# EAGLE board Resistor_Resistor (EAGLE 8.3.0), part 25 of 32
## Placement (x,y rotation side) (continued)
R30455  10K  [0201]  210.67,34.19 0 top
R30456  10K  [0201]  210.67,34.8 0 top
R30457  10K  [0201]  210.67,35.41 0 top
R30458  10K  [0201]  210.67,36.02 0 top
R30459  10K  [0201]  210.67,36.63 0 top
R30460  10K  [0201]  210.67,37.24 0 top
R30461  10K  [0201]  210.67,37.85 0 top
R30462  10K  [0201]  210.67,38.46 0 top
R30463  10K  [0201]  210.67,39.07 0 top
R30464  10K  [0201]  210.67,39.67 0 top
R30465  10K  [0201]  210.67,40.28 0 top
R30466  10K  [0201]  210.67,40.89 0 top
R30467  10K  [0201]  210.67,41.5 0 top
R30468  10K  [0201]  210.67,42.11 0 top
R30469  10K  [0201]  210.67,42.72 0 top
R30470  10K  [0201]  210.67,43.33 0 top
R30471  10K  [0201]  210.67,43.94 0 top
R30472  10K  [0201]  210.67,44.55 0 top
R30473  10K  [0201]  210.67,45.16 0 top
R30474  10K  [0201]  210.67,45.77 0 top
R30475  10K  [0201]  210.67,46.38 0 top
R30476  10K  [0201]  210.67,46.99 0 top
R30477  10K  [0201]  210.67,47.6 0 top
R30478  10K  [0201]  210.67,48.21 0 top
R30479  10K  [0201]  210.67,48.82 0 top
R30480  10K  [0201]  210.67,49.43 0 top
R30481  10K  [0201]  210.67,50.04 0 top
R30482  10K  [0201]  210.67,50.65 0 top
R30483  10K  [0201]  210.67,51.26 0 top
R30484  10K  [0201]  210.67,51.87 0 top
R30485  10K  [0201]  210.67,52.48 0 top
R30486  10K  [0201]  210.67,53.09 0 top
R30487  10K  [0201]  210.67,53.7 0 top
R30488  10K  [0201]  210.67,54.31 0 top
R30489  10K  [0201]  210.67,54.91 0 top
R30490  10K  [0201]  210.67,55.52 0 top
R30491  10K  [0201]  210.67,56.13 0 top
R30492  10K  [0201]  210.67,56.74 0 top
R30493  10K  [0201]  210.67,57.35 0 top
R30494  10K  [0201]  210.67,57.96 0 top
R30495  10K  [0201]  210.67,58.57 0 top
R30496  10K  [0201]  210.67,59.18 0 top
R30497  10K  [0201]  210.67,59.79 0 top
R30498  10K  [0201]  210.67,60.4 0 top
R30499  10K  [0201]  210.67,61.01 0 top
R30500  10K  [0201]  210.67,61.62 0 top
R30501  10K  [0201]  210.67,62.23 0 top
R30502  10K  [0201]  210.67,62.84 0 top
R30503  10K  [0201]  210.67,63.45 0 top
R30504  10K  [0201]  210.67,64.06 0 top
R30505  10K  [0201]  210.67,64.67 0 top
R30506  10K  [0201]  210.67,65.28 0 top
R30507  10K  [0201]  210.67,65.89 0 top
R30508  10K  [0201]  210.67,66.5 0 top
R30509  10K  [0201]  210.67,67.11 0 top
R30510  10K  [0201]  210.67,67.72 0 top
R30511  10K  [0201]  210.67,68.33 0 top
R30512  10K  [0201]  210.67,68.94 0 top
R30513  10K  [0201]  210.67,69.55 0 top
R30514  10K  [0201]  210.67,70.15 0 top
R30515  10K  [0201]  210.67,70.76 0 top
R30516  10K  [0201]  210.67,71.37 0 top
R30517  10K  [0201]  210.67,71.98 0 top
R30518  10K  [0201]  210.67,72.59 0 top
R30519  10K  [0201]  210.67,73.2 0 top
R30520  10K  [0201]  210.67,73.81 0 top
R30521  10K  [0201]  210.67,74.42 0 top
R30522  10K  [0201]  210.67,75.03 0 top
R30523  10K  [0201]  210.67,75.64 0 top
R30524  10K  [0201]  210.67,76.25 0 top
R30525  10K  [0201]  210.67,76.86 0 top
R30526  10K  [0201]  210.67,77.47 0 top
R30527  10K  [0201]  210.67,78.08 0 top
R30528  10K  [0201]  210.67,78.69 0 top
R30529  10K  [0201]  210.67,79.3 0 top
R30530  10K  [0201]  210.67,79.91 0 top
R30531  10K  [0201]  210.67,80.52 0 top
R30532  10K  [0201]  210.67,81.13 0 top
R30533  10K  [0201]  210.67,81.74 0 top
R30534  10K  [0201]  210.67,82.35 0 top
R30535  10K  [0201]  210.67,82.96 0 top
R30536  10K  [0201]  210.67,83.57 0 top
R30537  10K  [0201]  210.67,84.18 0 top
R30538  10K  [0201]  210.67,84.79 0 top
R30539  10K  [0201]  210.67,85.39 0 top
R30540  10K  [0201]  210.67,86 0 top
R30541  10K  [0201]  210.67,86.61 0 top
R30542  10K  [0201]  210.67,87.22 0 top
R30543  10K  [0201]  210.67,87.83 0 top
R30544  10K  [0201]  210.67,88.44 0 top
R30545  10K  [0201]  210.67,89.05 0 top
R30546  10K  [0201]  210.67,89.66 0 top
R30547  10K  [0201]  210.67,90.27 0 top
R30548  10K  [0201]  210.67,90.88 0 top
R30549  10K  [0201]  210.67,91.49 0 top
R30550  10K  [0201]  210.67,92.1 0 top
R30551  10K  [0201]  210.67,92.71 0 top
R30552  10K  [0201]  210.67,93.32 0 top
R30553  10K  [0201]  210.67,93.93 0 top
R30554  10K  [0201]  210.67,94.54 0 top
R30555  10K  [0201]  210.67,95.15 0 top
R30556  10K  [0201]  210.67,95.76 0 top
R30557  10K  [0201]  210.67,96.37 0 top
R30558  10K  [0201]  210.67,96.98 0 top
R30559  10K  [0201]  210.67,97.59 0 top
R30560  10K  [0201]  210.67,98.2 0 top
R30561  10K  [0201]  210.67,98.81 0 top
R30562  10K  [0201]  210.67,99.42 0 top
R30563  10K  [0201]  210.67,100.03 0 top
R30564  10K  [0201]  210.67,100.63 0 top
R30565  10K  [0201]  210.67,101.24 0 top
R30566  10K  [0201]  210.67,101.85 0 top
R30567  10K  [0201]  210.67,102.46 0 top
R30568  10K  [0201]  210.67,103.07 0 top
R30569  10K  [0201]  210.67,103.68 0 top
R30570  10K  [0201]  210.67,104.29 0 top
R30571  10K  [0201]  210.67,104.9 0 top
R30572  10K  [0201]  210.67,105.51 0 top
R30573  10K  [0201]  210.67,106.12 0 top
R30574  10K  [0201]  210.67,106.73 0 top
R30575  10K  [0201]  210.67,107.34 0 top
R30576  10K  [0201]  210.67,107.95 0 top
R30577  10K  [0201]  210.67,108.56 0 top
R30578  10K  [0201]  210.67,109.17 0 top
R30579  10K  [0201]  210.67,109.78 0 top
R30580  10K  [0201]  210.67,110.39 0 top
R30581  10K  [0201]  210.67,111 0 top
R30582  10K  [0201]  210.67,111.61 0 top
R30583  10K  [0201]  210.67,112.22 0 top
R30584  10K  [0201]  210.67,112.83 0 top
R30585  10K  [0201]  210.67,113.44 0 top
R30586  10K  [0201]  210.67,114.05 0 top
R30587  10K  [0201]  210.67,114.66 0 top
R30588  10K  [0201]  210.67,115.27 0 top
R30589  10K  [0201]  210.67,115.87 0 top
R30590  10K  [0201]  210.67,116.48 0 top
R30591  10K  [0201]  210.67,117.09 0 top
R30592  10K  [0201]  210.67,117.7 0 top
R30593  10K  [0201]  210.67,118.31 0 top
R30594  10K  [0201]  210.67,118.92 0 top
R30595  10K  [0201]  210.67,119.53 0 top
R30596  10K  [0201]  210.67,120.14 0 top
R30597  10K  [0201]  210.67,120.75 0 top
R30598  10K  [0201]  210.67,121.36 0 top
R30599  10K  [0201]  210.67,121.97 0 top
R30600  10K  [0201]  210.67,122.58 0 top
R30601  10K  [0201]  211.89,1.27 0 top
R30602  10K  [0201]  211.89,1.88 0 top
R30603  10K  [0201]  211.89,2.49 0 top
R30604  10K  [0201]  211.89,3.1 0 top
R30605  10K  [0201]  211.89,3.71 0 top
R30606  10K  [0201]  211.89,4.32 0 top
R30607  10K  [0201]  211.89,4.93 0 top
R30608  10K  [0201]  211.89,5.54 0 top
R30609  10K  [0201]  211.89,6.15 0 top
R30610  10K  [0201]  211.89,6.76 0 top
R30611  10K  [0201]  211.89,7.37 0 top
R30612  10K  [0201]  211.89,7.98 0 top
R30613  10K  [0201]  211.89,8.59 0 top
R30614  10K  [0201]  211.89,9.19 0 top
R30615  10K  [0201]  211.89,9.8 0 top
R30616  10K  [0201]  211.89,10.41 0 top
R30617  10K  [0201]  211.89,11.02 0 top
R30618  10K  [0201]  211.89,11.63 0 top
R30619  10K  [0201]  211.89,12.24 0 top
R30620  10K  [0201]  211.89,12.85 0 top
R30621  10K  [0201]  211.89,13.46 0 top
R30622  10K  [0201]  211.89,14.07 0 top
R30623  10K  [0201]  211.89,14.68 0 top
R30624  10K  [0201]  211.89,15.29 0 top
R30625  10K  [0201]  211.89,15.9 0 top
R30626  10K  [0201]  211.89,16.51 0 top
R30627  10K  [0201]  211.89,17.12 0 top
R30628  10K  [0201]  211.89,17.73 0 top
R30629  10K  [0201]  211.89,18.34 0 top
R30630  10K  [0201]  211.89,18.95 0 top
R30631  10K  [0201]  211.89,19.56 0 top
R30632  10K  [0201]  211.89,20.17 0 top
R30633  10K  [0201]  211.89,20.78 0 top
R30634  10K  [0201]  211.89,21.39 0 top
R30635  10K  [0201]  211.89,22 0 top
R30636  10K  [0201]  211.89,22.61 0 top
R30637  10K  [0201]  211.89,23.22 0 top
R30638  10K  [0201]  211.89,23.83 0 top
R30639  10K  [0201]  211.89,24.43 0 top
R30640  10K  [0201]  211.89,25.04 0 top
R30641  10K  [0201]  211.89,25.65 0 top
R30642  10K  [0201]  211.89,26.26 0 top
R30643  10K  [0201]  211.89,26.87 0 top
R30644  10K  [0201]  211.89,27.48 0 top
R30645  10K  [0201]  211.89,28.09 0 top
R30646  10K  [0201]  211.89,28.7 0 top
R30647  10K  [0201]  211.89,29.31 0 top
R30648  10K  [0201]  211.89,29.92 0 top
R30649  10K  [0201]  211.89,30.53 0 top
R30650  10K  [0201]  211.89,31.14 0 top
R30651  10K  [0201]  211.89,31.75 0 top
R30652  10K  [0201]  211.89,32.36 0 top
R30653  10K  [0201]  211.89,32.97 0 top
R30654  10K  [0201]  211.89,33.58 0 top
R30655  10K  [0201]  211.89,34.19 0 top
R30656  10K  [0201]  211.89,34.8 0 top
R30657  10K  [0201]  211.89,35.41 0 top
R30658  10K  [0201]  211.89,36.02 0 top
R30659  10K  [0201]  211.89,36.63 0 top
R30660  10K  [0201]  211.89,37.24 0 top
R30661  10K  [0201]  211.89,37.85 0 top
R30662  10K  [0201]  211.89,38.46 0 top
R30663  10K  [0201]  211.89,39.07 0 top
R30664  10K  [0201]  211.89,39.67 0 top
R30665  10K  [0201]  211.89,40.28 0 top
R30666  10K  [0201]  211.89,40.89 0 top
R30667  10K  [0201]  211.89,41.5 0 top
R30668  10K  [0201]  211.89,42.11 0 top
R30669  10K  [0201]  211.89,42.72 0 top
R30670  10K  [0201]  211.89,43.33 0 top
R30671  10K  [0201]  211.89,43.94 0 top
R30672  10K  [0201]  211.89,44.55 0 top
R30673  10K  [0201]  211.89,45.16 0 top
R30674  10K  [0201]  211.89,45.77 0 top
R30675  10K  [0201]  211.89,46.38 0 top
R30676  10K  [0201]  211.89,46.99 0 top
R30677  10K  [0201]  211.89,47.6 0 top
R30678  10K  [0201]  211.89,48.21 0 top
R30679  10K  [0201]  211.89,48.82 0 top
R30680  10K  [0201]  211.89,49.43 0 top
R30681  10K  [0201]  211.89,50.04 0 top
R30682  10K  [0201]  211.89,50.65 0 top
R30683  10K  [0201]  211.89,51.26 0 top
R30684  10K  [0201]  211.89,51.87 0 top
R30685  10K  [0201]  211.89,52.48 0 top
R30686  10K  [0201]  211.89,53.09 0 top
R30687  10K  [0201]  211.89,53.7 0 top
R30688  10K  [0201]  211.89,54.31 0 top
R30689  10K  [0201]  211.89,54.91 0 top
R30690  10K  [0201]  211.89,55.52 0 top
R30691  10K  [0201]  211.89,56.13 0 top
R30692  10K  [0201]  211.89,56.74 0 top
R30693  10K  [0201]  211.89,57.35 0 top
R30694  10K  [0201]  211.89,57.96 0 top
R30695  10K  [0201]  211.89,58.57 0 top
R30696  10K  [0201]  211.89,59.18 0 top
R30697  10K  [0201]  211.89,59.79 0 top
R30698  10K  [0201]  211.89,60.4 0 top
R30699  10K  [0201]  211.89,61.01 0 top
R30700  10K  [0201]  211.89,61.62 0 top
R30701  10K  [0201]  211.89,62.23 0 top
R30702  10K  [0201]  211.89,62.84 0 top
R30703  10K  [0201]  211.89,63.45 0 top
R30704  10K  [0201]  211.89,64.06 0 top
R30705  10K  [0201]  211.89,64.67 0 top
R30706  10K  [0201]  211.89,65.28 0 top
R30707  10K  [0201]  211.89,65.89 0 top
R30708  10K  [0201]  211.89,66.5 0 top
R30709  10K  [0201]  211.89,67.11 0 top
R30710  10K  [0201]  211.89,67.72 0 top
R30711  10K  [0201]  211.89,68.33 0 top
R30712  10K  [0201]  211.89,68.94 0 top
R30713  10K  [0201]  211.89,69.55 0 top
R30714  10K  [0201]  211.89,70.15 0 top
R30715  10K  [0201]  211.89,70.76 0 top
R30716  10K  [0201]  211.89,71.37 0 top
R30717  10K  [0201]  211.89,71.98 0 top
R30718  10K  [0201]  211.89,72.59 0 top
R30719  10K  [0201]  211.89,73.2 0 top
R30720  10K  [0201]  211.89,73.81 0 top
R30721  10K  [0201]  211.89,74.42 0 top
R30722  10K  [0201]  211.89,75.03 0 top
R30723  10K  [0201]  211.89,75.64 0 top
R30724  10K  [0201]  211.89,76.25 0 top
R30725  10K  [0201]  211.89,76.86 0 top
R30726  10K  [0201]  211.89,77.47 0 top
R30727  10K  [0201]  211.89,78.08 0 top
R30728  10K  [0201]  211.89,78.69 0 top
R30729  10K  [0201]  211.89,79.3 0 top
R30730  10K  [0201]  211.89,79.91 0 top
R30731  10K  [0201]  211.89,80.52 0 top
R30732  10K  [0201]  211.89,81.13 0 top
R30733  10K  [0201]  211.89,81.74 0 top
R30734  10K  [0201]  211.89,82.35 0 top
R30735  10K  [0201]  211.89,82.96 0 top
R30736  10K  [0201]  211.89,83.57 0 top
R30737  10K  [0201]  211.89,84.18 0 top
R30738  10K  [0201]  211.89,84.79 0 top
R30739  10K  [0201]  211.89,85.39 0 top
R30740  10K  [0201]  211.89,86 0 top
R30741  10K  [0201]  211.89,86.61 0 top
R30742  10K  [0201]  211.89,87.22 0 top
R30743  10K  [0201]  211.89,87.83 0 top
R30744  10K  [0201]  211.89,88.44 0 top
R30745  10K  [0201]  211.89,89.05 0 top
R30746  10K  [0201]  211.89,89.66 0 top
R30747  10K  [0201]  211.89,90.27 0 top
R30748  10K  [0201]  211.89,90.88 0 top
R30749  10K  [0201]  211.89,91.49 0 top
R30750  10K  [0201]  211.89,92.1 0 top
R30751  10K  [0201]  211.89,92.71 0 top
R30752  10K  [0201]  211.89,93.32 0 top
R30753  10K  [0201]  211.89,93.93 0 top
R30754  10K  [0201]  211.89,94.54 0 top
R30755  10K  [0201]  211.89,95.15 0 top
R30756  10K  [0201]  211.89,95.76 0 top
R30757  10K  [0201]  211.89,96.37 0 top
R30758  10K  [0201]  211.89,96.98 0 top
R30759  10K  [0201]  211.89,97.59 0 top
R30760  10K  [0201]  211.89,98.2 0 top
R30761  10K  [0201]  211.89,98.81 0 top
R30762  10K  [0201]  211.89,99.42 0 top
R30763  10K  [0201]  211.89,100.03 0 top
R30764  10K  [0201]  211.89,100.63 0 top
R30765  10K  [0201]  211.89,101.24 0 top
R30766  10K  [0201]  211.89,101.85 0 top
R30767  10K  [0201]  211.89,102.46 0 top
R30768  10K  [0201]  211.89,103.07 0 top
R30769  10K  [0201]  211.89,103.68 0 top
R30770  10K  [0201]  211.89,104.29 0 top
R30771  10K  [0201]  211.89,104.9 0 top
R30772  10K  [0201]  211.89,105.51 0 top
R30773  10K  [0201]  211.89,106.12 0 top
R30774  10K  [0201]  211.89,106.73 0 top
R30775  10K  [0201]  211.89,107.34 0 top
R30776  10K  [0201]  211.89,107.95 0 top
R30777  10K  [0201]  211.89,108.56 0 top
R30778  10K  [0201]  211.89,109.17 0 top
R30779  10K  [0201]  211.89,109.78 0 top
R30780  10K  [0201]  211.89,110.39 0 top
R30781  10K  [0201]  211.89,111 0 top
R30782  10K  [0201]  211.89,111.61 0 top
R30783  10K  [0201]  211.89,112.22 0 top
R30784  10K  [0201]  211.89,112.83 0 top
R30785  10K  [0201]  211.89,113.44 0 top
R30786  10K  [0201]  211.89,114.05 0 top
R30787  10K  [0201]  211.89,114.66 0 top
R30788  10K  [0201]  211.89,115.27 0 top
R30789  10K  [0201]  211.89,115.87 0 top
R30790  10K  [0201]  211.89,116.48 0 top
R30791  10K  [0201]  211.89,117.09 0 top
R30792  10K  [0201]  211.89,117.7 0 top
R30793  10K  [0201]  211.89,118.31 0 top
R30794  10K  [0201]  211.89,118.92 0 top
R30795  10K  [0201]  211.89,119.53 0 top
R30796  10K  [0201]  211.89,120.14 0 top
R30797  10K  [0201]  211.89,120.75 0 top
R30798  10K  [0201]  211.89,121.36 0 top
R30799  10K  [0201]  211.89,121.97 0 top
R30800  10K  [0201]  211.89,122.58 0 top
R30801  10K  [0201]  213.11,1.27 0 top
R30802  10K  [0201]  213.11,1.88 0 top
R30803  10K  [0201]  213.11,2.49 0 top
R30804  10K  [0201]  213.11,3.1 0 top
R30805  10K  [0201]  213.11,3.71 0 top
R30806  10K  [0201]  213.11,4.32 0 top
R30807  10K  [0201]  213.11,4.93 0 top
R30808  10K  [0201]  213.11,5.54 0 top
R30809  10K  [0201]  213.11,6.15 0 top
R30810  10K  [0201]  213.11,6.76 0 top
R30811  10K  [0201]  213.11,7.37 0 top
R30812  10K  [0201]  213.11,7.98 0 top
R30813  10K  [0201]  213.11,8.59 0 top
R30814  10K  [0201]  213.11,9.19 0 top
R30815  10K  [0201]  213.11,9.8 0 top
R30816  10K  [0201]  213.11,10.41 0 top
R30817  10K  [0201]  213.11,11.02 0 top
R30818  10K  [0201]  213.11,11.63 0 top
R30819  10K  [0201]  213.11,12.24 0 top
R30820  10K  [0201]  213.11,12.85 0 top
R30821  10K  [0201]  213.11,13.46 0 top
R30822  10K  [0201]  213.11,14.07 0 top
R30823  10K  [0201]  213.11,14.68 0 top
R30824  10K  [0201]  213.11,15.29 0 top
R30825  10K  [0201]  213.11,15.9 0 top
R30826  10K  [0201]  213.11,16.51 0 top
R30827  10K  [0201]  213.11,17.12 0 top
R30828  10K  [0201]  213.11,17.73 0 top
R30829  10K  [0201]  213.11,18.34 0 top
R30830  10K  [0201]  213.11,18.95 0 top
R30831  10K  [0201]  213.11,19.56 0 top
R30832  10K  [0201]  213.11,20.17 0 top
R30833  10K  [0201]  213.11,20.78 0 top
R30834  10K  [0201]  213.11,21.39 0 top
R30835  10K  [0201]  213.11,22 0 top
R30836  10K  [0201]  213.11,22.61 0 top
R30837  10K  [0201]  213.11,23.22 0 top
R30838  10K  [0201]  213.11,23.83 0 top
R30839  10K  [0201]  213.11,24.43 0 top
R30840  10K  [0201]  213.11,25.04 0 top
R30841  10K  [0201]  213.11,25.65 0 top
R30842  10K  [0201]  213.11,26.26 0 top
R30843  10K  [0201]  213.11,26.87 0 top
R30844  10K  [0201]  213.11,27.48 0 top
R30845  10K  [0201]  213.11,28.09 0 top
R30846  10K  [0201]  213.11,28.7 0 top
R30847  10K  [0201]  213.11,29.31 0 top
R30848  10K  [0201]  213.11,29.92 0 top
R30849  10K  [0201]  213.11,30.53 0 top
R30850  10K  [0201]  213.11,31.14 0 top
R30851  10K  [0201]  213.11,31.75 0 top
R30852  10K  [0201]  213.11,32.36 0 top
R30853  10K  [0201]  213.11,32.97 0 top
R30854  10K  [0201]  213.11,33.58 0 top
R30855  10K  [0201]  213.11,34.19 0 top
R30856  10K  [0201]  213.11,34.8 0 top
R30857  10K  [0201]  213.11,35.41 0 top
R30858  10K  [0201]  213.11,36.02 0 top
R30859  10K  [0201]  213.11,36.63 0 top
R30860  10K  [0201]  213.11,37.24 0 top
R30861  10K  [0201]  213.11,37.85 0 top
R30862  10K  [0201]  213.11,38.46 0 top
R30863  10K  [0201]  213.11,39.07 0 top
R30864  10K  [0201]  213.11,39.67 0 top
R30865  10K  [0201]  213.11,40.28 0 top
R30866  10K  [0201]  213.11,40.89 0 top
R30867  10K  [0201]  213.11,41.5 0 top
R30868  10K  [0201]  213.11,42.11 0 top
R30869  10K  [0201]  213.11,42.72 0 top
R30870  10K  [0201]  213.11,43.33 0 top
R30871  10K  [0201]  213.11,43.94 0 top
R30872  10K  [0201]  213.11,44.55 0 top
R30873  10K  [0201]  213.11,45.16 0 top
R30874  10K  [0201]  213.11,45.77 0 top
R30875  10K  [0201]  213.11,46.38 0 top
R30876  10K  [0201]  213.11,46.99 0 top
R30877  10K  [0201]  213.11,47.6 0 top
R30878  10K  [0201]  213.11,48.21 0 top
R30879  10K  [0201]  213.11,48.82 0 top
R30880  10K  [0201]  213.11,49.43 0 top
R30881  10K  [0201]  213.11,50.04 0 top
R30882  10K  [0201]  213.11,50.65 0 top
R30883  10K  [0201]  213.11,51.26 0 top
R30884  10K  [0201]  213.11,51.87 0 top
R30885  10K  [0201]  213.11,52.48 0 top
R30886  10K  [0201]  213.11,53.09 0 top
R30887  10K  [0201]  213.11,53.7 0 top
R30888  10K  [0201]  213.11,54.31 0 top
R30889  10K  [0201]  213.11,54.91 0 top
R30890  10K  [0201]  213.11,55.52 0 top
R30891  10K  [0201]  213.11,56.13 0 top
R30892  10K  [0201]  213.11,56.74 0 top
R30893  10K  [0201]  213.11,57.35 0 top
R30894  10K  [0201]  213.11,57.96 0 top
R30895  10K  [0201]  213.11,58.57 0 top
R30896  10K  [0201]  213.11,59.18 0 top
R30897  10K  [0201]  213.11,59.79 0 top
R30898  10K  [0201]  213.11,60.4 0 top
R30899  10K  [0201]  213.11,61.01 0 top
R30900  10K  [0201]  213.11,61.62 0 top
R30901  10K  [0201]  213.11,62.23 0 top
R30902  10K  [0201]  213.11,62.84 0 top
R30903  10K  [0201]  213.11,63.45 0 top
R30904  10K  [0201]  213.11,64.06 0 top
R30905  10K  [0201]  213.11,64.67 0 top
R30906  10K  [0201]  213.11,65.28 0 top
R30907  10K  [0201]  213.11,65.89 0 top
R30908  10K  [0201]  213.11,66.5 0 top
R30909  10K  [0201]  213.11,67.11 0 top
R30910  10K  [0201]  213.11,67.72 0 top
R30911  10K  [0201]  213.11,68.33 0 top
R30912  10K  [0201]  213.11,68.94 0 top
R30913  10K  [0201]  213.11,69.55 0 top
R30914  10K  [0201]  213.11,70.15 0 top
R30915  10K  [0201]  213.11,70.76 0 top
R30916  10K  [0201]  213.11,71.37 0 top
R30917  10K  [0201]  213.11,71.98 0 top
R30918  10K  [0201]  213.11,72.59 0 top
R30919  10K  [0201]  213.11,73.2 0 top
R30920  10K  [0201]  213.11,73.81 0 top
R30921  10K  [0201]  213.11,74.42 0 top
R30922  10K  [0201]  213.11,75.03 0 top
R30923  10K  [0201]  213.11,75.64 0 top
R30924  10K  [0201]  213.11,76.25 0 top
R30925  10K  [0201]  213.11,76.86 0 top
R30926  10K  [0201]  213.11,77.47 0 top
R30927  10K  [0201]  213.11,78.08 0 top
R30928  10K  [0201]  213.11,78.69 0 top
R30929  10K  [0201]  213.11,79.3 0 top
R30930  10K  [0201]  213.11,79.91 0 top
R30931  10K  [0201]  213.11,80.52 0 top
R30932  10K  [0201]  213.11,81.13 0 top
R30933  10K  [0201]  213.11,81.74 0 top
R30934  10K  [0201]  213.11,82.35 0 top
R30935  10K  [0201]  213.11,82.96 0 top
R30936  10K  [0201]  213.11,83.57 0 top
R30937  10K  [0201]  213.11,84.18 0 top
R30938  10K  [0201]  213.11,84.79 0 top
R30939  10K  [0201]  213.11,85.39 0 top
R30940  10K  [0201]  213.11,86 0 top
R30941  10K  [0201]  213.11,86.61 0 top
R30942  10K  [0201]  213.11,87.22 0 top
R30943  10K  [0201]  213.11,87.83 0 top
R30944  10K  [0201]  213.11,88.44 0 top
R30945  10K  [0201]  213.11,89.05 0 top
R30946  10K  [0201]  213.11,89.66 0 top
R30947  10K  [0201]  213.11,90.27 0 top
R30948  10K  [0201]  213.11,90.88 0 top
R30949  10K  [0201]  213.11,91.49 0 top
R30950  10K  [0201]  213.11,92.1 0 top
R30951  10K  [0201]  213.11,92.71 0 top
R30952  10K  [0201]  213.11,93.32 0 top
R30953  10K  [0201]  213.11,93.93 0 top
R30954  10K  [0201]  213.11,94.54 0 top
R30955  10K  [0201]  213.11,95.15 0 top
R30956  10K  [0201]  213.11,95.76 0 top
R30957  10K  [0201]  213.11,96.37 0 top
R30958  10K  [0201]  213.11,96.98 0 top
R30959  10K  [0201]  213.11,97.59 0 top
R30960  10K  [0201]  213.11,98.2 0 top
R30961  10K  [0201]  213.11,98.81 0 top
R30962  10K  [0201]  213.11,99.42 0 top
R30963  10K  [0201]  213.11,100.03 0 top
R30964  10K  [0201]  213.11,100.63 0 top
R30965  10K  [0201]  213.11,101.24 0 top
R30966  10K  [0201]  213.11,101.85 0 top
R30967  10K  [0201]  213.11,102.46 0 top
R30968  10K  [0201]  213.11,103.07 0 top
R30969  10K  [0201]  213.11,103.68 0 top
R30970  10K  [0201]  213.11,104.29 0 top
R30971  10K  [0201]  213.11,104.9 0 top
R30972  10K  [0201]  213.11,105.51 0 top
R30973  10K  [0201]  213.11,106.12 0 top
R30974  10K  [0201]  213.11,106.73 0 top
R30975  10K  [0201]  213.11,107.34 0 top
R30976  10K  [0201]  213.11,107.95 0 top
R30977  10K  [0201]  213.11,108.56 0 top
R30978  10K  [0201]  213.11,109.17 0 top
R30979  10K  [0201]  213.11,109.78 0 top
R30980  10K  [0201]  213.11,110.39 0 top
R30981  10K  [0201]  213.11,111 0 top
R30982  10K  [0201]  213.11,111.61 0 top
R30983  10K  [0201]  213.11,112.22 0 top
R30984  10K  [0201]  213.11,112.83 0 top
R30985  10K  [0201]  213.11,113.44 0 top
R30986  10K  [0201]  213.11,114.05 0 top
R30987  10K  [0201]  213.11,114.66 0 top
R30988  10K  [0201]  213.11,115.27 0 top
R30989  10K  [0201]  213.11,115.87 0 top
R30990  10K  [0201]  213.11,116.48 0 top
R30991  10K  [0201]  213.11,117.09 0 top
R30992  10K  [0201]  213.11,117.7 0 top
R30993  10K  [0201]  213.11,118.31 0 top
R30994  10K  [0201]  213.11,118.92 0 top
R30995  10K  [0201]  213.11,119.53 0 top
R30996  10K  [0201]  213.11,120.14 0 top
R30997  10K  [0201]  213.11,120.75 0 top
R30998  10K  [0201]  213.11,121.36 0 top
R30999  10K  [0201]  213.11,121.97 0 top
R31000  10K  [0201]  213.11,122.58 0 top
R31001  10K  [0201]  214.33,1.27 0 top
R31002  10K  [0201]  214.33,1.88 0 top
R31003  10K  [0201]  214.33,2.49 0 top
R31004  10K  [0201]  214.33,3.1 0 top
R31005  10K  [0201]  214.33,3.71 0 top
R31006  10K  [0201]  214.33,4.32 0 top
R31007  10K  [0201]  214.33,4.93 0 top
R31008  10K  [0201]  214.33,5.54 0 top
R31009  10K  [0201]  214.33,6.15 0 top
R31010  10K  [0201]  214.33,6.76 0 top
R31011  10K  [0201]  214.33,7.37 0 top
R31012  10K  [0201]  214.33,7.98 0 top
R31013  10K  [0201]  214.33,8.59 0 top
R31014  10K  [0201]  214.33,9.19 0 top
R31015  10K  [0201]  214.33,9.8 0 top
R31016  10K  [0201]  214.33,10.41 0 top
R31017  10K  [0201]  214.33,11.02 0 top
R31018  10K  [0201]  214.33,11.63 0 top
R31019  10K  [0201]  214.33,12.24 0 top
R31020  10K  [0201]  214.33,12.85 0 top
R31021  10K  [0201]  214.33,13.46 0 top
R31022  10K  [0201]  214.33,14.07 0 top
R31023  10K  [0201]  214.33,14.68 0 top
R31024  10K  [0201]  214.33,15.29 0 top
R31025  10K  [0201]  214.33,15.9 0 top
R31026  10K  [0201]  214.33,16.51 0 top
R31027  10K  [0201]  214.33,17.12 0 top
R31028  10K  [0201]  214.33,17.73 0 top
R31029  10K  [0201]  214.33,18.34 0 top
R31030  10K  [0201]  214.33,18.95 0 top
R31031  10K  [0201]  214.33,19.56 0 top
R31032  10K  [0201]  214.33,20.17 0 top
R31033  10K  [0201]  214.33,20.78 0 top
R31034  10K  [0201]  214.33,21.39 0 top
R31035  10K  [0201]  214.33,22 0 top
R31036  10K  [0201]  214.33,22.61 0 top
R31037  10K  [0201]  214.33,23.22 0 top
R31038  10K  [0201]  214.33,23.83 0 top
R31039  10K  [0201]  214.33,24.43 0 top
R31040  10K  [0201]  214.33,25.04 0 top
R31041  10K  [0201]  214.33,25.65 0 top
R31042  10K  [0201]  214.33,26.26 0 top
R31043  10K  [0201]  214.33,26.87 0 top
R31044  10K  [0201]  214.33,27.48 0 top
R31045  10K  [0201]  214.33,28.09 0 top
R31046  10K  [0201]  214.33,28.7 0 top
R31047  10K  [0201]  214.33,29.31 0 top
R31048  10K  [0201]  214.33,29.92 0 top
R31049  10K  [0201]  214.33,30.53 0 top
R31050  10K  [0201]  214.33,31.14 0 top
R31051  10K  [0201]  214.33,31.75 0 top
R31052  10K  [0201]  214.33,32.36 0 top
R31053  10K  [0201]  214.33,32.97 0 top
R31054  10K  [0201]  214.33,33.58 0 top
R31055  10K  [0201]  214.33,34.19 0 top
R31056  10K  [0201]  214.33,34.8 0 top
R31057  10K  [0201]  214.33,35.41 0 top
R31058  10K  [0201]  214.33,36.02 0 top
R31059  10K  [0201]  214.33,36.63 0 top
R31060  10K  [0201]  214.33,37.24 0 top
R31061  10K  [0201]  214.33,37.85 0 top
R31062  10K  [0201]  214.33,38.46 0 top
R31063  10K  [0201]  214.33,39.07 0 top
R31064  10K  [0201]  214.33,39.67 0 top
R31065  10K  [0201]  214.33,40.28 0 top
R31066  10K  [0201]  214.33,40.89 0 top
R31067  10K  [0201]  214.33,41.5 0 top
R31068  10K  [0201]  214.33,42.11 0 top
R31069  10K  [0201]  214.33,42.72 0 top
R31070  10K  [0201]  214.33,43.33 0 top
R31071  10K  [0201]  214.33,43.94 0 top
R31072  10K  [0201]  214.33,44.55 0 top
R31073  10K  [0201]  214.33,45.16 0 top
R31074  10K  [0201]  214.33,45.77 0 top
R31075  10K  [0201]  214.33,46.38 0 top
R31076  10K  [0201]  214.33,46.99 0 top
R31077  10K  [0201]  214.33,47.6 0 top
R31078  10K  [0201]  214.33,48.21 0 top
R31079  10K  [0201]  214.33,48.82 0 top
R31080  10K  [0201]  214.33,49.43 0 top
R31081  10K  [0201]  214.33,50.04 0 top
R31082  10K  [0201]  214.33,50.65 0 top
R31083  10K  [0201]  214.33,51.26 0 top
R31084  10K  [0201]  214.33,51.87 0 top
R31085  10K  [0201]  214.33,52.48 0 top
R31086  10K  [0201]  214.33,53.09 0 top
R31087  10K  [0201]  214.33,53.7 0 top
R31088  10K  [0201]  214.33,54.31 0 top
R31089  10K  [0201]  214.33,54.91 0 top
R31090  10K  [0201]  214.33,55.52 0 top
R31091  10K  [0201]  214.33,56.13 0 top
R31092  10K  [0201]  214.33,56.74 0 top
R31093  10K  [0201]  214.33,57.35 0 top
R31094  10K  [0201]  214.33,57.96 0 top
R31095  10K  [0201]  214.33,58.57 0 top
R31096  10K  [0201]  214.33,59.18 0 top
R31097  10K  [0201]  214.33,59.79 0 top
R31098  10K  [0201]  214.33,60.4 0 top
R31099  10K  [0201]  214.33,61.01 0 top
R31100  10K  [0201]  214.33,61.62 0 top
R31101  10K  [0201]  214.33,62.23 0 top
R31102  10K  [0201]  214.33,62.84 0 top
R31103  10K  [0201]  214.33,63.45 0 top
R31104  10K  [0201]  214.33,64.06 0 top
R31105  10K  [0201]  214.33,64.67 0 top
R31106  10K  [0201]  214.33,65.28 0 top
R31107  10K  [0201]  214.33,65.89 0 top
R31108  10K  [0201]  214.33,66.5 0 top
R31109  10K  [0201]  214.33,67.11 0 top
R31110  10K  [0201]  214.33,67.72 0 top
R31111  10K  [0201]  214.33,68.33 0 top
R31112  10K  [0201]  214.33,68.94 0 top
R31113  10K  [0201]  214.33,69.55 0 top
R31114  10K  [0201]  214.33,70.15 0 top
R31115  10K  [0201]  214.33,70.76 0 top
R31116  10K  [0201]  214.33,71.37 0 top
R31117  10K  [0201]  214.33,71.98 0 top
R31118  10K  [0201]  214.33,72.59 0 top
R31119  10K  [0201]  214.33,73.2 0 top
R31120  10K  [0201]  214.33,73.81 0 top
R31121  10K  [0201]  214.33,74.42 0 top
R31122  10K  [0201]  214.33,75.03 0 top
R31123  10K  [0201]  214.33,75.64 0 top
R31124  10K  [0201]  214.33,76.25 0 top
R31125  10K  [0201]  214.33,76.86 0 top
R31126  10K  [0201]  214.33,77.47 0 top
R31127  10K  [0201]  214.33,78.08 0 top
R31128  10K  [0201]  214.33,78.69 0 top
R31129  10K  [0201]  214.33,79.3 0 top
R31130  10K  [0201]  214.33,79.91 0 top
R31131  10K  [0201]  214.33,80.52 0 top
R31132  10K  [0201]  214.33,81.13 0 top
R31133  10K  [0201]  214.33,81.74 0 top
R31134  10K  [0201]  214.33,82.35 0 top
R31135  10K  [0201]  214.33,82.96 0 top
R31136  10K  [0201]  214.33,83.57 0 top
R31137  10K  [0201]  214.33,84.18 0 top
R31138  10K  [0201]  214.33,84.79 0 top
R31139  10K  [0201]  214.33,85.39 0 top
R31140  10K  [0201]  214.33,86 0 top
R31141  10K  [0201]  214.33,86.61 0 top
R31142  10K  [0201]  214.33,87.22 0 top
R31143  10K  [0201]  214.33,87.83 0 top
R31144  10K  [0201]  214.33,88.44 0 top
R31145  10K  [0201]  214.33,89.05 0 top
R31146  10K  [0201]  214.33,89.66 0 top
R31147  10K  [0201]  214.33,90.27 0 top
R31148  10K  [0201]  214.33,90.88 0 top
R31149  10K  [0201]  214.33,91.49 0 top
R31150  10K  [0201]  214.33,92.1 0 top
R31151  10K  [0201]  214.33,92.71 0 top
R31152  10K  [0201]  214.33,93.32 0 top
R31153  10K  [0201]  214.33,93.93 0 top
R31154  10K  [0201]  214.33,94.54 0 top
R31155  10K  [0201]  214.33,95.15 0 top
R31156  10K  [0201]  214.33,95.76 0 top
R31157  10K  [0201]  214.33,96.37 0 top
R31158  10K  [0201]  214.33,96.98 0 top
R31159  10K  [0201]  214.33,97.59 0 top
R31160  10K  [0201]  214.33,98.2 0 top
R31161  10K  [0201]  214.33,98.81 0 top
R31162  10K  [0201]  214.33,99.42 0 top
R31163  10K  [0201]  214.33,100.03 0 top
R31164  10K  [0201]  214.33,100.63 0 top
R31165  10K  [0201]  214.33,101.24 0 top
R31166  10K  [0201]  214.33,101.85 0 top
R31167  10K  [0201]  214.33,102.46 0 top
R31168  10K  [0201]  214.33,103.07 0 top
R31169  10K  [0201]  214.33,103.68 0 top
R31170  10K  [0201]  214.33,104.29 0 top
R31171  10K  [0201]  214.33,104.9 0 top
R31172  10K  [0201]  214.33,105.51 0 top
R31173  10K  [0201]  214.33,106.12 0 top
R31174  10K  [0201]  214.33,106.73 0 top
R31175  10K  [0201]  214.33,107.34 0 top
R31176  10K  [0201]  214.33,107.95 0 top
R31177  10K  [0201]  214.33,108.56 0 top
R31178  10K  [0201]  214.33,109.17 0 top
R31179  10K  [0201]  214.33,109.78 0 top
R31180  10K  [0201]  214.33,110.39 0 top
R31181  10K  [0201]  214.33,111 0 top
R31182  10K  [0201]  214.33,111.61 0 top
R31183  10K  [0201]  214.33,112.22 0 top
R31184  10K  [0201]  214.33,112.83 0 top
R31185  10K  [0201]  214.33,113.44 0 top
R31186  10K  [0201]  214.33,114.05 0 top
R31187  10K  [0201]  214.33,114.66 0 top
R31188  10K  [0201]  214.33,115.27 0 top
R31189  10K  [0201]  214.33,115.87 0 top
R31190  10K  [0201]  214.33,116.48 0 top
R31191  10K  [0201]  214.33,117.09 0 top
R31192  10K  [0201]  214.33,117.7 0 top
R31193  10K  [0201]  214.33,118.31 0 top
R31194  10K  [0201]  214.33,118.92 0 top
R31195  10K  [0201]  214.33,119.53 0 top
R31196  10K  [0201]  214.33,120.14 0 top
R31197  10K  [0201]  214.33,120.75 0 top
R31198  10K  [0201]  214.33,121.36 0 top
R31199  10K  [0201]  214.33,121.97 0 top
R31200  10K  [0201]  214.33,122.58 0 top
R31201  10K  [0201]  215.54,1.27 0 top
R31202  10K  [0201]  215.54,1.88 0 top
R31203  10K  [0201]  215.54,2.49 0 top
R31204  10K  [0201]  215.54,3.1 0 top
R31205  10K  [0201]  215.54,3.71 0 top
R31206  10K  [0201]  215.54,4.32 0 top
R31207  10K  [0201]  215.54,4.93 0 top
R31208  10K  [0201]  215.54,5.54 0 top
R31209  10K  [0201]  215.54,6.15 0 top
R31210  10K  [0201]  215.54,6.76 0 top
R31211  10K  [0201]  215.54,7.37 0 top
R31212  10K  [0201]  215.54,7.98 0 top
R31213  10K  [0201]  215.54,8.59 0 top
R31214  10K  [0201]  215.54,9.19 0 top
R31215  10K  [0201]  215.54,9.8 0 top
R31216  10K  [0201]  215.54,10.41 0 top
R31217  10K  [0201]  215.54,11.02 0 top
R31218  10K  [0201]  215.54,11.63 0 top
R31219  10K  [0201]  215.54,12.24 0 top
R31220  10K  [0201]  215.54,12.85 0 top
R31221  10K  [0201]  215.54,13.46 0 top
R31222  10K  [0201]  215.54,14.07 0 top
R31223  10K  [0201]  215.54,14.68 0 top
R31224  10K  [0201]  215.54,15.29 0 top
R31225  10K  [0201]  215.54,15.9 0 top
R31226  10K  [0201]  215.54,16.51 0 top
R31227  10K  [0201]  215.54,17.12 0 top
R31228  10K  [0201]  215.54,17.73 0 top
R31229  10K  [0201]  215.54,18.34 0 top
R31230  10K  [0201]  215.54,18.95 0 top
R31231  10K  [0201]  215.54,19.56 0 top
R31232  10K  [0201]  215.54,20.17 0 top
R31233  10K  [0201]  215.54,20.78 0 top
R31234  10K  [0201]  215.54,21.39 0 top
R31235  10K  [0201]  215.54,22 0 top
R31236  10K  [0201]  215.54,22.61 0 top
R31237  10K  [0201]  215.54,23.22 0 top
R31238  10K  [0201]  215.54,23.83 0 top
R31239  10K  [0201]  215.54,24.43 0 top
R31240  10K  [0201]  215.54,25.04 0 top
R31241  10K  [0201]  215.54,25.65 0 top
R31242  10K  [0201]  215.54,26.26 0 top
R31243  10K  [0201]  215.54,26.87 0 top
R31244  10K  [0201]  215.54,27.48 0 top
R31245  10K  [0201]  215.54,28.09 0 top
R31246  10K  [0201]  215.54,28.7 0 top
R31247  10K  [0201]  215.54,29.31 0 top
R31248  10K  [0201]  215.54,29.92 0 top
R31249  10K  [0201]  215.54,30.53 0 top
R31250  10K  [0201]  215.54,31.14 0 top
R31251  10K  [0201]  215.54,31.75 0 top
R31252  10K  [0201]  215.54,32.36 0 top
R31253  10K  [0201]  215.54,32.97 0 top
R31254  10K  [0201]  215.54,33.58 0 top
R31255  10K  [0201]  215.54,34.19 0 top
R31256  10K  [0201]  215.54,34.8 0 top
R31257  10K  [0201]  215.54,35.41 0 top
R31258  10K  [0201]  215.54,36.02 0 top
R31259  10K  [0201]  215.54,36.63 0 top
R31260  10K  [0201]  215.54,37.24 0 top
R31261  10K  [0201]  215.54,37.85 0 top
R31262  10K  [0201]  215.54,38.46 0 top
R31263  10K  [0201]  215.54,39.07 0 top
R31264  10K  [0201]  215.54,39.67 0 top
R31265  10K  [0201]  215.54,40.28 0 top
R31266  10K  [0201]  215.54,40.89 0 top
R31267  10K  [0201]  215.54,41.5 0 top
R31268  10K  [0201]  215.54,42.11 0 top
R31269  10K  [0201]  215.54,42.72 0 top
R31270  10K  [0201]  215.54,43.33 0 top
R31271  10K  [0201]  215.54,43.94 0 top
R31272  10K  [0201]  215.54,44.55 0 top
R31273  10K  [0201]  215.54,45.16 0 top
R31274  10K  [0201]  215.54,45.77 0 top
R31275  10K  [0201]  215.54,46.38 0 top
R31276  10K  [0201]  215.54,46.99 0 top
R31277  10K  [0201]  215.54,47.6 0 top
R31278  10K  [0201]  215.54,48.21 0 top
R31279  10K  [0201]  215.54,48.82 0 top
R31280  10K  [0201]  215.54,49.43 0 top
R31281  10K  [0201]  215.54,50.04 0 top
R31282  10K  [0201]  215.54,50.65 0 top
R31283  10K  [0201]  215.54,51.26 0 top
R31284  10K  [0201]  215.54,51.87 0 top
R31285  10K  [0201]  215.54,52.48 0 top
R31286  10K  [0201]  215.54,53.09 0 top
R31287  10K  [0201]  215.54,53.7 0 top
R31288  10K  [0201]  215.54,54.31 0 top
R31289  10K  [0201]  215.54,54.91 0 top
R31290  10K  [0201]  215.54,55.52 0 top
R31291  10K  [0201]  215.54,56.13 0 top
R31292  10K  [0201]  215.54,56.74 0 top
R31293  10K  [0201]  215.54,57.35 0 top
R31294  10K  [0201]  215.54,57.96 0 top
R31295  10K  [0201]  215.54,58.57 0 top
R31296  10K  [0201]  215.54,59.18 0 top
R31297  10K  [0201]  215.54,59.79 0 top
R31298  10K  [0201]  215.54,60.4 0 top
R31299  10K  [0201]  215.54,61.01 0 top
R31300  10K  [0201]  215.54,61.62 0 top
R31301  10K  [0201]  215.54,62.23 0 top
R31302  10K  [0201]  215.54,62.84 0 top
R31303  10K  [0201]  215.54,63.45 0 top
R31304  10K  [0201]  215.54,64.06 0 top
R31305  10K  [0201]  215.54,64.67 0 top
R31306  10K  [0201]  215.54,65.28 0 top
R31307  10K  [0201]  215.54,65.89 0 top
R31308  10K  [0201]  215.54,66.5 0 top
R31309  10K  [0201]  215.54,67.11 0 top
R31310  10K  [0201]  215.54,67.72 0 top
R31311  10K  [0201]  215.54,68.33 0 top
R31312  10K  [0201]  215.54,68.94 0 top
R31313  10K  [0201]  215.54,69.55 0 top
R31314  10K  [0201]  215.54,70.15 0 top
R31315  10K  [0201]  215.54,70.76 0 top
R31316  10K  [0201]  215.54,71.37 0 top
R31317  10K  [0201]  215.54,71.98 0 top
R31318  10K  [0201]  215.54,72.59 0 top
R31319  10K  [0201]  215.54,73.2 0 top
R31320  10K  [0201]  215.54,73.81 0 top
R31321  10K  [0201]  215.54,74.42 0 top
R31322  10K  [0201]  215.54,75.03 0 top
R31323  10K  [0201]  215.54,75.64 0 top
R31324  10K  [0201]  215.54,76.25 0 top
R31325  10K  [0201]  215.54,76.86 0 top
R31326  10K  [0201]  215.54,77.47 0 top
R31327  10K  [0201]  215.54,78.08 0 top
R31328  10K  [0201]  215.54,78.69 0 top
R31329  10K  [0201]  215.54,79.3 0 top
R31330  10K  [0201]  215.54,79.91 0 top
R31331  10K  [0201]  215.54,80.52 0 top
R31332  10K  [0201]  215.54,81.13 0 top
R31333  10K  [0201]  215.54,81.74 0 top
R31334  10K  [0201]  215.54,82.35 0 top
R31335  10K  [0201]  215.54,82.96 0 top
R31336  10K  [0201]  215.54,83.57 0 top
R31337  10K  [0201]  215.54,84.18 0 top
R31338  10K  [0201]  215.54,84.79 0 top
R31339  10K  [0201]  215.54,85.39 0 top
R31340  10K  [0201]  215.54,86 0 top
R31341  10K  [0201]  215.54,86.61 0 top
R31342  10K  [0201]  215.54,87.22 0 top
R31343  10K  [0201]  215.54,87.83 0 top
R31344  10K  [0201]  215.54,88.44 0 top
R31345  10K  [0201]  215.54,89.05 0 top
R31346  10K  [0201]  215.54,89.66 0 top
R31347  10K  [0201]  215.54,90.27 0 top
R31348  10K  [0201]  215.54,90.88 0 top
R31349  10K  [0201]  215.54,91.49 0 top
R31350  10K  [0201]  215.54,92.1 0 top
R31351  10K  [0201]  215.54,92.71 0 top
R31352  10K  [0201]  215.54,93.32 0 top
R31353  10K  [0201]  215.54,93.93 0 top
R31354  10K  [0201]  215.54,94.54 0 top
R31355  10K  [0201]  215.54,95.15 0 top
R31356  10K  [0201]  215.54,95.76 0 top
R31357  10K  [0201]  215.54,96.37 0 top
R31358  10K  [0201]  215.54,96.98 0 top
R31359  10K  [0201]  215.54,97.59 0 top
R31360  10K  [0201]  215.54,98.2 0 top
R31361  10K  [0201]  215.54,98.81 0 top
R31362  10K  [0201]  215.54,99.42 0 top
R31363  10K  [0201]  215.54,100.03 0 top
R31364  10K  [0201]  215.54,100.63 0 top
R31365  10K  [0201]  215.54,101.24 0 top
R31366  10K  [0201]  215.54,101.85 0 top
R31367  10K  [0201]  215.54,102.46 0 top
R31368  10K  [0201]  215.54,103.07 0 top
R31369  10K  [0201]  215.54,103.68 0 top
R31370  10K  [0201]  215.54,104.29 0 top
R31371  10K  [0201]  215.54,104.9 0 top
R31372  10K  [0201]  215.54,105.51 0 top
R31373  10K  [0201]  215.54,106.12 0 top
R31374  10K  [0201]  215.54,106.73 0 top
R31375  10K  [0201]  215.54,107.34 0 top
R31376  10K  [0201]  215.54,107.95 0 top
R31377  10K  [0201]  215.54,108.56 0 top
R31378  10K  [0201]  215.54,109.17 0 top
R31379  10K  [0201]  215.54,109.78 0 top
R31380  10K  [0201]  215.54,110.39 0 top
R31381  10K  [0201]  215.54,111 0 top
R31382  10K  [0201]  215.54,111.61 0 top
R31383  10K  [0201]  215.54,112.22 0 top
R31384  10K  [0201]  215.54,112.83 0 top
R31385  10K  [0201]  215.54,113.44 0 top
R31386  10K  [0201]  215.54,114.05 0 top
R31387  10K  [0201]  215.54,114.66 0 top
R31388  10K  [0201]  215.54,115.27 0 top
R31389  10K  [0201]  215.54,115.87 0 top
R31390  10K  [0201]  215.54,116.48 0 top
R31391  10K  [0201]  215.54,117.09 0 top
R31392  10K  [0201]  215.54,117.7 0 top
R31393  10K  [0201]  215.54,118.31 0 top
R31394  10K  [0201]  215.54,118.92 0 top
R31395  10K  [0201]  215.54,119.53 0 top
R31396  10K  [0201]  215.54,120.14 0 top
R31397  10K  [0201]  215.54,120.75 0 top
R31398  10K  [0201]  215.54,121.36 0 top
R31399  10K  [0201]  215.54,121.97 0 top
R31400  10K  [0201]  215.54,122.58 0 top
R31401  10K  [0201]  216.76,1.27 0 top
R31402  10K  [0201]  216.76,1.88 0 top
R31403  10K  [0201]  216.76,2.49 0 top
R31404  10K  [0201]  216.76,3.1 0 top
R31405  10K  [0201]  216.76,3.71 0 top
R31406  10K  [0201]  216.76,4.32 0 top
R31407  10K  [0201]  216.76,4.93 0 top
R31408  10K  [0201]  216.76,5.54 0 top
R31409  10K  [0201]  216.76,6.15 0 top
R31410  10K  [0201]  216.76,6.76 0 top
R31411  10K  [0201]  216.76,7.37 0 top
R31412  10K  [0201]  216.76,7.98 0 top
R31413  10K  [0201]  216.76,8.59 0 top
R31414  10K  [0201]  216.76,9.19 0 top
R31415  10K  [0201]  216.76,9.8 0 top
R31416  10K  [0201]  216.76,10.41 0 top
R31417  10K  [0201]  216.76,11.02 0 top
R31418  10K  [0201]  216.76,11.63 0 top
R31419  10K  [0201]  216.76,12.24 0 top
R31420  10K  [0201]  216.76,12.85 0 top
R31421  10K  [0201]  216.76,13.46 0 top
R31422  10K  [0201]  216.76,14.07 0 top
R31423  10K  [0201]  216.76,14.68 0 top
R31424  10K  [0201]  216.76,15.29 0 top
R31425  10K  [0201]  216.76,15.9 0 top
R31426  10K  [0201]  216.76,16.51 0 top
R31427  10K  [0201]  216.76,17.12 0 top
R31428  10K  [0201]  216.76,17.73 0 top
R31429  10K  [0201]  216.76,18.34 0 top
R31430  10K  [0201]  216.76,18.95 0 top
R31431  10K  [0201]  216.76,19.56 0 top
R31432  10K  [0201]  216.76,20.17 0 top
R31433  10K  [0201]  216.76,20.78 0 top
R31434  10K  [0201]  216.76,21.39 0 top
R31435  10K  [0201]  216.76,22 0 top
R31436  10K  [0201]  216.76,22.61 0 top
R31437  10K  [0201]  216.76,23.22 0 top
R31438  10K  [0201]  216.76,23.83 0 top
R31439  10K  [0201]  216.76,24.43 0 top
R31440  10K  [0201]  216.76,25.04 0 top
R31441  10K  [0201]  216.76,25.65 0 top
R31442  10K  [0201]  216.76,26.26 0 top
R31443  10K  [0201]  216.76,26.87 0 top
R31444  10K  [0201]  216.76,27.48 0 top
R31445  10K  [0201]  216.76,28.09 0 top
R31446  10K  [0201]  216.76,28.7 0 top
R31447  10K  [0201]  216.76,29.31 0 top
R31448  10K  [0201]  216.76,29.92 0 top
R31449  10K  [0201]  216.76,30.53 0 top
R31450  10K  [0201]  216.76,31.14 0 top
R31451  10K  [0201]  216.76,31.75 0 top
R31452  10K  [0201]  216.76,32.36 0 top
R31453  10K  [0201]  216.76,32.97 0 top
R31454  10K  [0201]  216.76,33.58 0 top
R31455  10K  [0201]  216.76,34.19 0 top
R31456  10K  [0201]  216.76,34.8 0 top
R31457  10K  [0201]  216.76,35.41 0 top
R31458  10K  [0201]  216.76,36.02 0 top
R31459  10K  [0201]  216.76,36.63 0 top
R31460  10K  [0201]  216.76,37.24 0 top
R31461  10K  [0201]  216.76,37.85 0 top
R31462  10K  [0201]  216.76,38.46 0 top
R31463  10K  [0201]  216.76,39.07 0 top
R31464  10K  [0201]  216.76,39.67 0 top
R31465  10K  [0201]  216.76,40.28 0 top
R31466  10K  [0201]  216.76,40.89 0 top
R31467  10K  [0201]  216.76,41.5 0 top
R31468  10K  [0201]  216.76,42.11 0 top
R31469  10K  [0201]  216.76,42.72 0 top
R31470  10K  [0201]  216.76,43.33 0 top
R31471  10K  [0201]  216.76,43.94 0 top
R31472  10K  [0201]  216.76,44.55 0 top
R31473  10K  [0201]  216.76,45.16 0 top
R31474  10K  [0201]  216.76,45.77 0 top
R31475  10K  [0201]  216.76,46.38 0 top
R31476  10K  [0201]  216.76,46.99 0 top
R31477  10K  [0201]  216.76,47.6 0 top
R31478  10K  [0201]  216.76,48.21 0 top
R31479  10K  [0201]  216.76,48.82 0 top
R31480  10K  [0201]  216.76,49.43 0 top
R31481  10K  [0201]  216.76,50.04 0 top
R31482  10K  [0201]  216.76,50.65 0 top
R31483  10K  [0201]  216.76,51.26 0 top
R31484  10K  [0201]  216.76,51.87 0 top
R31485  10K  [0201]  216.76,52.48 0 top
R31486  10K  [0201]  216.76,53.09 0 top
R31487  10K  [0201]  216.76,53.7 0 top
R31488  10K  [0201]  216.76,54.31 0 top
R31489  10K  [0201]  216.76,54.91 0 top
R31490  10K  [0201]  216.76,55.52 0 top
R31491  10K  [0201]  216.76,56.13 0 top
R31492  10K  [0201]  216.76,56.74 0 top
R31493  10K  [0201]  216.76,57.35 0 top
R31494  10K  [0201]  216.76,57.96 0 top
R31495  10K  [0201]  216.76,58.57 0 top
R31496  10K  [0201]  216.76,59.18 0 top
R31497  10K  [0201]  216.76,59.79 0 top
R31498  10K  [0201]  216.76,60.4 0 top
R31499  10K  [0201]  216.76,61.01 0 top
R31500  10K  [0201]  216.76,61.62 0 top
R31501  10K  [0201]  216.76,62.23 0 top
R31502  10K  [0201]  216.76,62.84 0 top
R31503  10K  [0201]  216.76,63.45 0 top
R31504  10K  [0201]  216.76,64.06 0 top
R31505  10K  [0201]  216.76,64.67 0 top
R31506  10K  [0201]  216.76,65.28 0 top
R31507  10K  [0201]  216.76,65.89 0 top
R31508  10K  [0201]  216.76,66.5 0 top
R31509  10K  [0201]  216.76,67.11 0 top
R31510  10K  [0201]  216.76,67.72 0 top
R31511  10K  [0201]  216.76,68.33 0 top
R31512  10K  [0201]  216.76,68.94 0 top
R31513  10K  [0201]  216.76,69.55 0 top
R31514  10K  [0201]  216.76,70.15 0 top
R31515  10K  [0201]  216.76,70.76 0 top
R31516  10K  [0201]  216.76,71.37 0 top
R31517  10K  [0201]  216.76,71.98 0 top
R31518  10K  [0201]  216.76,72.59 0 top
R31519  10K  [0201]  216.76,73.2 0 top
R31520  10K  [0201]  216.76,73.81 0 top
R31521  10K  [0201]  216.76,74.42 0 top
R31522  10K  [0201]  216.76,75.03 0 top
R31523  10K  [0201]  216.76,75.64 0 top
R31524  10K  [0201]  216.76,76.25 0 top
R31525  10K  [0201]  216.76,76.86 0 top
R31526  10K  [0201]  216.76,77.47 0 top
R31527  10K  [0201]  216.76,78.08 0 top
R31528  10K  [0201]  216.76,78.69 0 top
R31529  10K  [0201]  216.76,79.3 0 top
R31530  10K  [0201]  216.76,79.91 0 top
R31531  10K  [0201]  216.76,80.52 0 top
R31532  10K  [0201]  216.76,81.13 0 top
R31533  10K  [0201]  216.76,81.74 0 top
R31534  10K  [0201]  216.76,82.35 0 top
R31535  10K  [0201]  216.76,82.96 0 top
R31536  10K  [0201]  216.76,83.57 0 top
R31537  10K  [0201]  216.76,84.18 0 top
R31538  10K  [0201]  216.76,84.79 0 top
R31539  10K  [0201]  216.76,85.39 0 top
R31540  10K  [0201]  216.76,86 0 top
R31541  10K  [0201]  216.76,86.61 0 top
R31542  10K  [0201]  216.76,87.22 0 top
R31543  10K  [0201]  216.76,87.83 0 top
R31544  10K  [0201]  216.76,88.44 0 top
R31545  10K  [0201]  216.76,89.05 0 top
R31546  10K  [0201]  216.76,89.66 0 top
R31547  10K  [0201]  216.76,90.27 0 top
R31548  10K  [0201]  216.76,90.88 0 top
R31549  10K  [0201]  216.76,91.49 0 top
R31550  10K  [0201]  216.76,92.1 0 top
R31551  10K  [0201]  216.76,92.71 0 top
R31552  10K  [0201]  216.76,93.32 0 top
R31553  10K  [0201]  216.76,93.93 0 top
R31554  10K  [0201]  216.76,94.54 0 top
R31555  10K  [0201]  216.76,95.15 0 top
R31556  10K  [0201]  216.76,95.76 0 top
R31557  10K  [0201]  216.76,96.37 0 top
R31558  10K  [0201]  216.76,96.98 0 top
R31559  10K  [0201]  216.76,97.59 0 top
R31560  10K  [0201]  216.76,98.2 0 top
R31561  10K  [0201]  216.76,98.81 0 top
R31562  10K  [0201]  216.76,99.42 0 top
R31563  10K  [0201]  216.76,100.03 0 top
R31564  10K  [0201]  216.76,100.63 0 top
R31565  10K  [0201]  216.76,101.24 0 top
R31566  10K  [0201]  216.76,101.85 0 top
R31567  10K  [0201]  216.76,102.46 0 top
R31568  10K  [0201]  216.76,103.07 0 top
R31569  10K  [0201]  216.76,103.68 0 top
R31570  10K  [0201]  216.76,104.29 0 top
R31571  10K  [0201]  216.76,104.9 0 top
R31572  10K  [0201]  216.76,105.51 0 top
R31573  10K  [0201]  216.76,106.12 0 top
R31574  10K  [0201]  216.76,106.73 0 top
R31575  10K  [0201]  216.76,107.34 0 top
R31576  10K  [0201]  216.76,107.95 0 top
R31577  10K  [0201]  216.76,108.56 0 top
R31578  10K  [0201]  216.76,109.17 0 top
R31579  10K  [0201]  216.76,109.78 0 top
R31580  10K  [0201]  216.76,110.39 0 top
R31581  10K  [0201]  216.76,111 0 top
R31582  10K  [0201]  216.76,111.61 0 top
R31583  10K  [0201]  216.76,112.22 0 top
R31584  10K  [0201]  216.76,112.83 0 top
R31585  10K  [0201]  216.76,113.44 0 top
R31586  10K  [0201]  216.76,114.05 0 top
R31587  10K  [0201]  216.76,114.66 0 top
R31588  10K  [0201]  216.76,115.27 0 top
R31589  10K  [0201]  216.76,115.87 0 top
R31590  10K  [0201]  216.76,116.48 0 top
R31591  10K  [0201]  216.76,117.09 0 top
R31592  10K  [0201]  216.76,117.7 0 top
R31593  10K  [0201]  216.76,118.31 0 top
R31594  10K  [0201]  216.76,118.92 0 top
R31595  10K  [0201]  216.76,119.53 0 top
R31596  10K  [0201]  216.76,120.14 0 top
R31597  10K  [0201]  216.76,120.75 0 top
R31598  10K  [0201]  216.76,121.36 0 top
R31599  10K  [0201]  216.76,121.97 0 top
R31600  10K  [0201]  216.76,122.58 0 top
R31601  10K  [0201]  217.98,1.27 0 top
R31602  10K  [0201]  217.98,1.88 0 top
R31603  10K  [0201]  217.98,2.49 0 top
R31604  10K  [0201]  217.98,3.1 0 top
R31605  10K  [0201]  217.98,3.71 0 top
R31606  10K  [0201]  217.98,4.32 0 top
R31607  10K  [0201]  217.98,4.93 0 top
R31608  10K  [0201]  217.98,5.54 0 top
R31609  10K  [0201]  217.98,6.15 0 top
R31610  10K  [0201]  217.98,6.76 0 top
R31611  10K  [0201]  217.98,7.37 0 top
R31612  10K  [0201]  217.98,7.98 0 top
R31613  10K  [0201]  217.98,8.59 0 top
R31614  10K  [0201]  217.98,9.19 0 top
R31615  10K  [0201]  217.98,9.8 0 top
R31616  10K  [0201]  217.98,10.41 0 top
R31617  10K  [0201]  217.98,11.02 0 top
R31618  10K  [0201]  217.98,11.63 0 top
R31619  10K  [0201]  217.98,12.24 0 top
R31620  10K  [0201]  217.98,12.85 0 top
R31621  10K  [0201]  217.98,13.46 0 top
R31622  10K  [0201]  217.98,14.07 0 top
R31623  10K  [0201]  217.98,14.68 0 top
R31624  10K  [0201]  217.98,15.29 0 top
R31625  10K  [0201]  217.98,15.9 0 top
R31626  10K  [0201]  217.98,16.51 0 top
R31627  10K  [0201]  217.98,17.12 0 top
R31628  10K  [0201]  217.98,17.73 0 top
R31629  10K  [0201]  217.98,18.34 0 top
R31630  10K  [0201]  217.98,18.95 0 top
R31631  10K  [0201]  217.98,19.56 0 top
R31632  10K  [0201]  217.98,20.17 0 top
R31633  10K  [0201]  217.98,20.78 0 top
R31634  10K  [0201]  217.98,21.39 0 top
R31635  10K  [0201]  217.98,22 0 top
R31636  10K  [0201]  217.98,22.61 0 top
R31637  10K  [0201]  217.98,23.22 0 top
R31638  10K  [0201]  217.98,23.83 0 top
R31639  10K  [0201]  217.98,24.43 0 top
R31640  10K  [0201]  217.98,25.04 0 top
R31641  10K  [0201]  217.98,25.65 0 top
R31642  10K  [0201]  217.98,26.26 0 top
R31643  10K  [0201]  217.98,26.87 0 top
R31644  10K  [0201]  217.98,27.48 0 top
R31645  10K  [0201]  217.98,28.09 0 top
R31646  10K  [0201]  217.98,28.7 0 top
R31647  10K  [0201]  217.98,29.31 0 top
R31648  10K  [0201]  217.98,29.92 0 top
R31649  10K  [0201]  217.98,30.53 0 top
R31650  10K  [0201]  217.98,31.14 0 top
R31651  10K  [0201]  217.98,31.75 0 top
R31652  10K  [0201]  217.98,32.36 0 top
R31653  10K  [0201]  217.98,32.97 0 top
R31654  10K  [0201]  217.98,33.58 0 top
R31655  10K  [0201]  217.98,34.19 0 top
R31656  10K  [0201]  217.98,34.8 0 top
R31657  10K  [0201]  217.98,35.41 0 top
R31658  10K  [0201]  217.98,36.02 0 top
R31659  10K  [0201]  217.98,36.63 0 top
R31660  10K  [0201]  217.98,37.24 0 top
R31661  10K  [0201]  217.98,37.85 0 top
R31662  10K  [0201]  217.98,38.46 0 top
R31663  10K  [0201]  217.98,39.07 0 top
R31664  10K  [0201]  217.98,39.67 0 top
R31665  10K  [0201]  217.98,40.28 0 top
R31666  10K  [0201]  217.98,40.89 0 top
R31667  10K  [0201]  217.98,41.5 0 top
R31668  10K  [0201]  217.98,42.11 0 top
R31669  10K  [0201]  217.98,42.72 0 top
R31670  10K  [0201]  217.98,43.33 0 top
R31671  10K  [0201]  217.98,43.94 0 top
R31672  10K  [0201]  217.98,44.55 0 top
R31673  10K  [0201]  217.98,45.16 0 top
R31674  10K  [0201]  217.98,45.77 0 top
R31675  10K  [0201]  217.98,46.38 0 top
R31676  10K  [0201]  217.98,46.99 0 top
R31677  10K  [0201]  217.98,47.6 0 top
R31678  10K  [0201]  217.98,48.21 0 top
R31679  10K  [0201]  217.98,48.82 0 top
R31680  10K  [0201]  217.98,49.43 0 top
R31681  10K  [0201]  217.98,50.04 0 top
R31682  10K  [0201]  217.98,50.65 0 top
R31683  10K  [0201]  217.98,51.26 0 top
R31684  10K  [0201]  217.98,51.87 0 top
R31685  10K  [0201]  217.98,52.48 0 top
R31686  10K  [0201]  217.98,53.09 0 top
R31687  10K  [0201]  217.98,53.7 0 top
R31688  10K  [0201]  217.98,54.31 0 top
R31689  10K  [0201]  217.98,54.91 0 top
R31690  10K  [0201]  217.98,55.52 0 top
R31691  10K  [0201]  217.98,56.13 0 top
R31692  10K  [0201]  217.98,56.74 0 top
R31693  10K  [0201]  217.98,57.35 0 top
R31694  10K  [0201]  217.98,57.96 0 top
R31695  10K  [0201]  217.98,58.57 0 top
R31696  10K  [0201]  217.98,59.18 0 top